# Altium schematic sheet SOC_PL_Banks_66_67_68_FMC.SchDoc: Title
size 420 x 297 mm; Author: G.Kasprowicz; CompanyName: WUT ISE; DrawnBy: G.Kasprowicz; Organization: WUT ISE; Address1: PW ISE; Address2: Nowowiejska 15/19 00-665 Warsaw; Address3: gkasprow@gmail.com; DocumentNumber: 14; Revision: 2; SheetNumber: 14; SheetTotal: 40; ModifiedBy: -; CheckedDate: -; Title2: Title 2; DivGrp: WUT ISE; Designer: G.Kasprowicz; ModifiedDate: -; ProjectName: Sensor Box
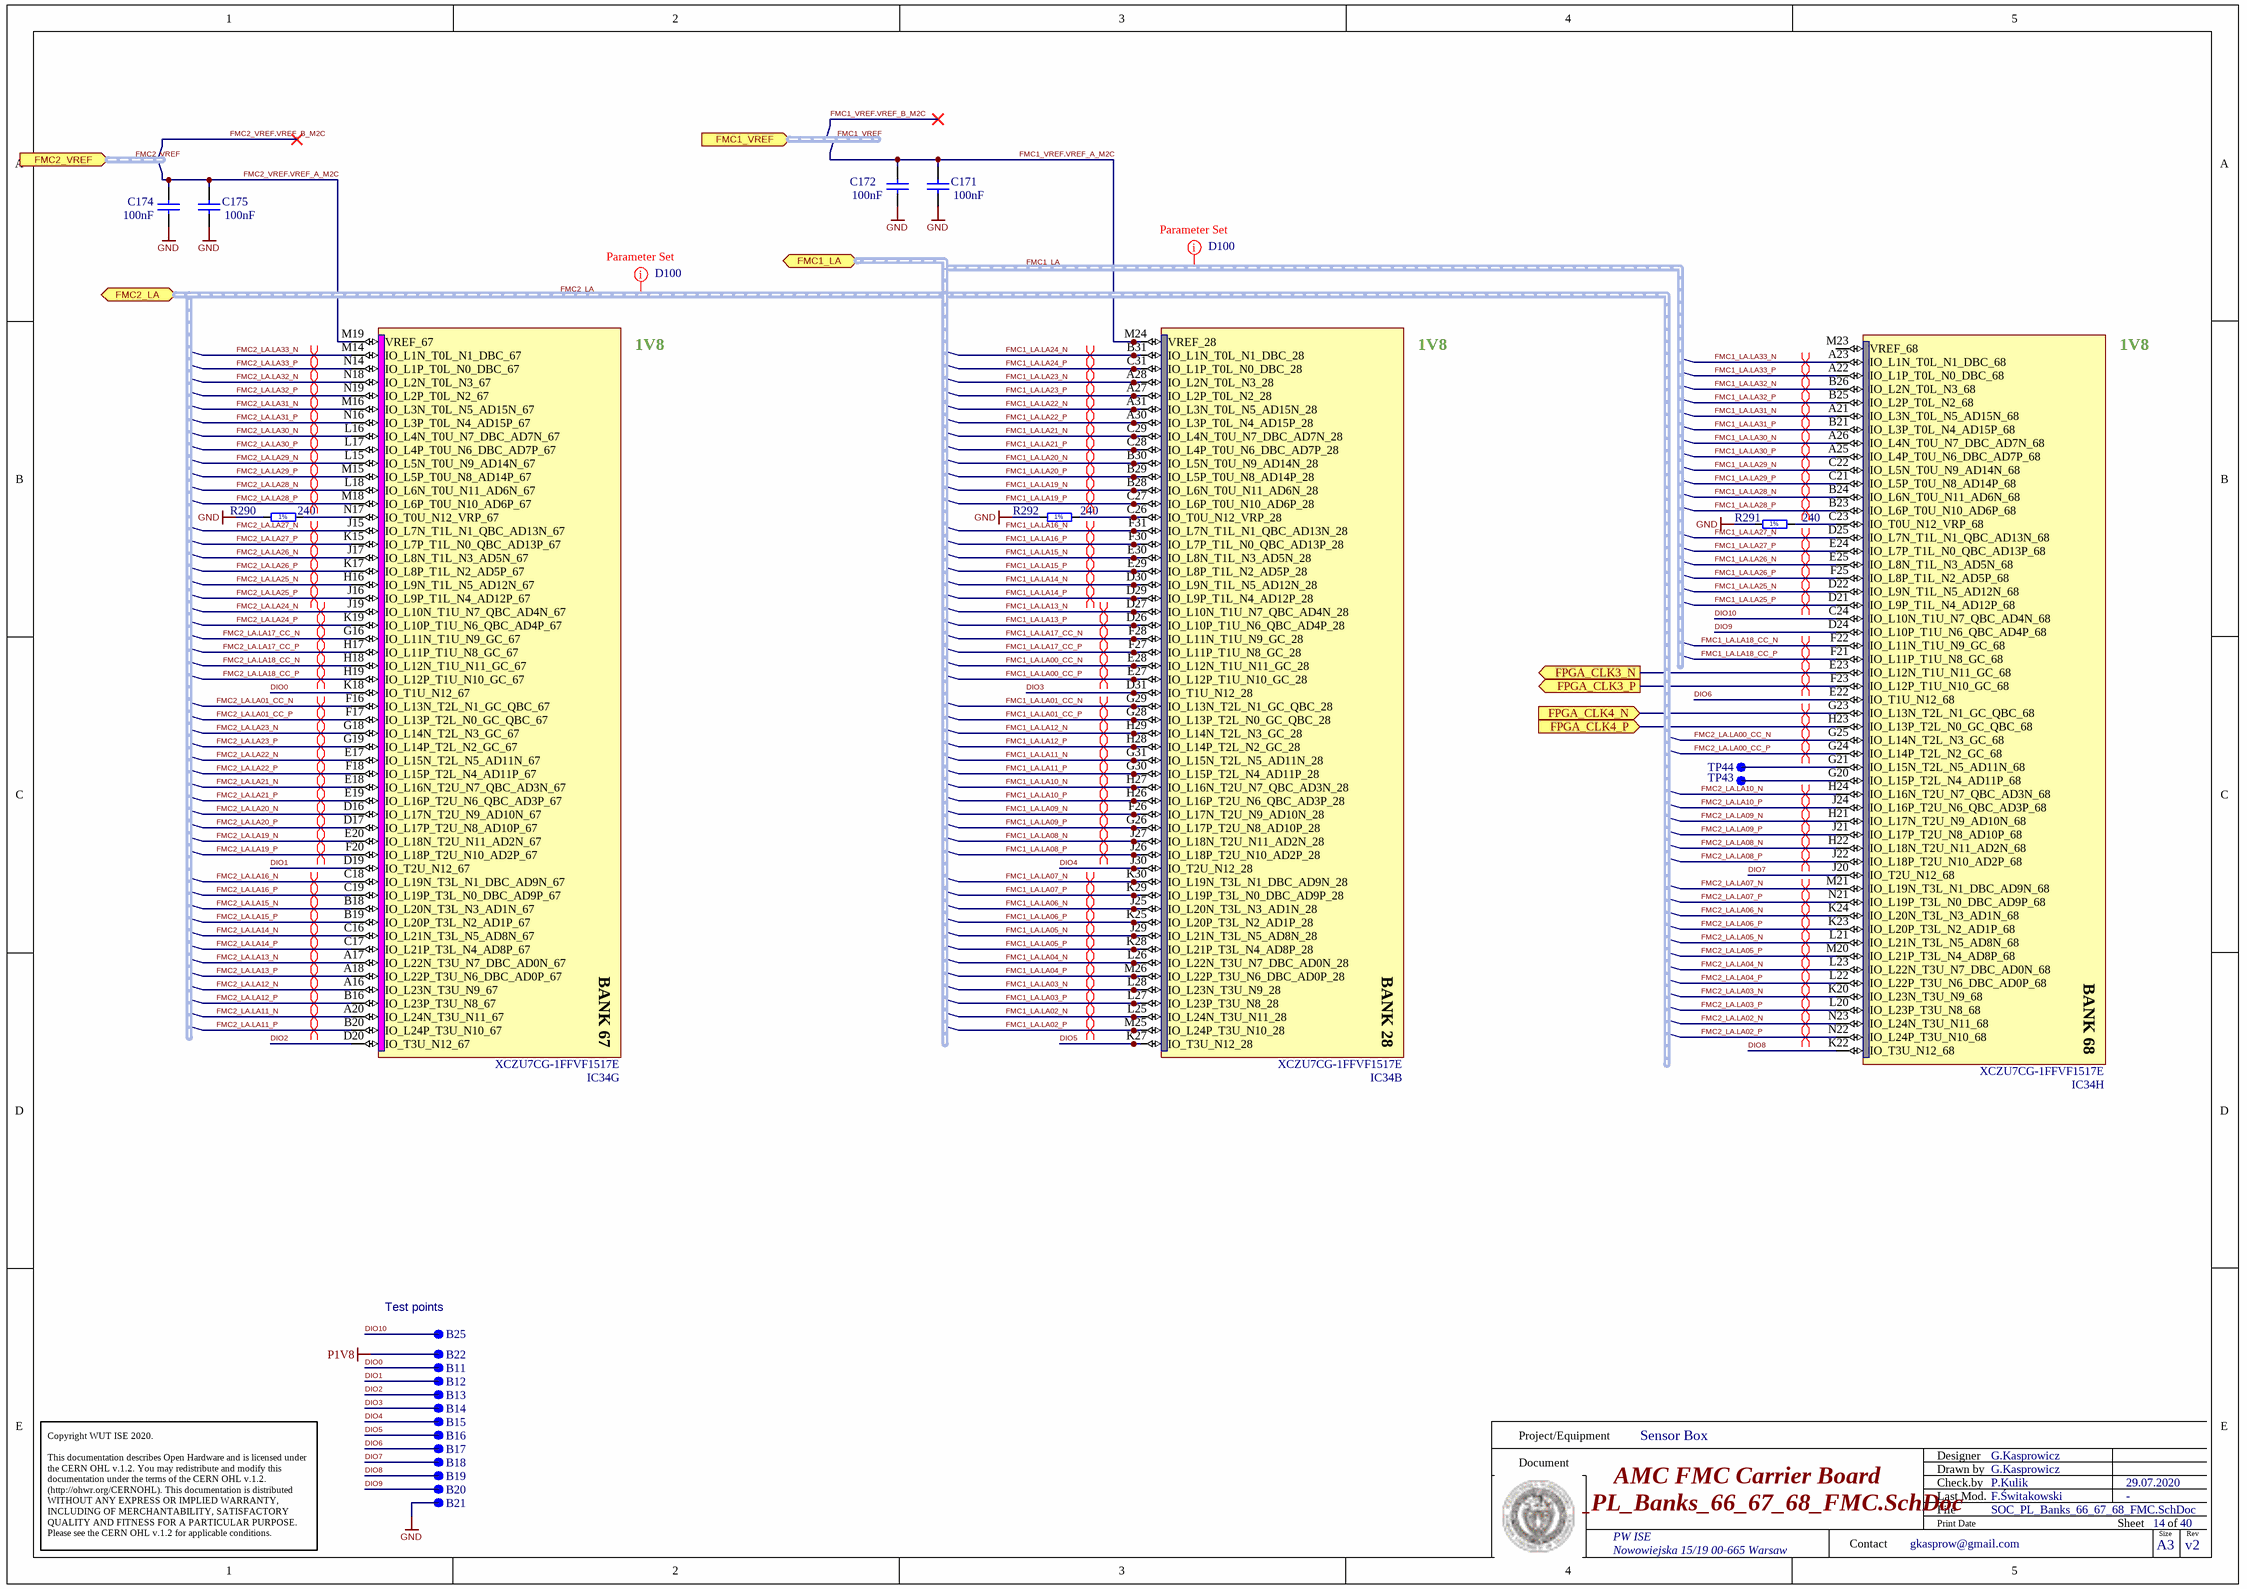
[diagram p0: SOC_PL_Banks_66_67_68_FMC.SchDoc]

## Parts
B11  SMD Pad  [C100]  (value not drawn)  (no BOM)
B12  SMD Pad  [C100]  (value not drawn)  (no BOM)
B13  SMD Pad  [C100]  (value not drawn)  (no BOM)
B14  SMD Pad  [C100]  (value not drawn)  (no BOM)
B15  SMD Pad  [C100]  (value not drawn)  (no BOM)
B16  SMD Pad  [C100]  (value not drawn)  (no BOM)
B17  SMD Pad  [C100]  (value not drawn)  (no BOM)
B18  SMD Pad  [C100]  (value not drawn)  (no BOM)
B19  SMD Pad  [C100]  (value not drawn)  (no BOM)
B20  SMD Pad  [C100]  (value not drawn)  (no BOM)
B21  SMD Pad  [C100]  (value not drawn)  (no BOM)
B22  SMD Pad  [C100]  (value not drawn)  (no BOM)
B25  SMD Pad  [C100]  (value not drawn)  (no BOM)
C171  100nF  [CAPC0603X33N]
C172  100nF  [CAPC0603X33N]
C174  100nF  [CAPC0603X33N]
C175  100nF  [CAPC0603X33N]
IC34  XCZU7CG-1FFVF1517E  [BGA1517C100P39X39_4000X4000X351]  (parts B,G,H of 28)
R290  240  [RESC1005X40N]
R291  240  [RESC1005X40N]
R292  240  [RESC1005X40N]
TP43  SMD Pad  [C100]  (value not drawn)  (no BOM)
TP44  SMD Pad  [C100]  (value not drawn)  (no BOM)

## Ports
FMC1_LA (bidir, harness FMC1_LA), FMC1_VREF (in, harness FMC1_VREF), FMC2_LA (bidir, harness FMC2_LA), FMC2_VREF (in, harness FMC2_VREF), FPGA_CLK3_N (out), FPGA_CLK3_P (out), FPGA_CLK4_N (in), FPGA_CLK4_P (in)

## Nets
GND: B21.1 C171.2 C172.2 C174.2 C175.2 R290.1 R291.1 R292.1
P1V8: B22.1
DIO0: B11.1 IC34.K18(IO_T1U_N12_67)
DIO1: B12.1 IC34.D19(IO_T2U_N12_67)
DIO2: B13.1 IC34.D20(IO_T3U_N12_67)
DIO3: B14.1 IC34.D31(IO_T1U_N12_28)
DIO4: B15.1 IC34.J30(IO_T2U_N12_28)
DIO5: B16.1 IC34.K27(IO_T3U_N12_28)
DIO6: B17.1 IC34.E22(IO_T1U_N12_68)
DIO7: B18.1 IC34.J20(IO_T2U_N12_68)
DIO8: B19.1 IC34.K22(IO_T3U_N12_68)
DIO9: B20.1 IC34.D24(IO_L10P_T1U_N6_QBC_AD4P_68)
DIO10: B25.1 IC34.C24(IO_L10N_T1U_N7_QBC_AD4N_68)
FMC1_LA.LA00_CC_N: IC34.E28(IO_L12N_T1U_N11_GC_28)
FMC1_LA.LA00_CC_P: IC34.E27(IO_L12P_T1U_N10_GC_28)
FMC1_LA.LA01_CC_N: IC34.G29(IO_L13N_T2L_N1_GC_QBC_28)
FMC1_LA.LA01_CC_P: IC34.G28(IO_L13P_T2L_N0_GC_QBC_28)
FMC1_LA.LA02_N: IC34.L25(IO_L24N_T3U_N11_28)
FMC1_LA.LA02_P: IC34.M25(IO_L24P_T3U_N10_28)
FMC1_LA.LA03_N: IC34.L28(IO_L23N_T3U_N9_28)
FMC1_LA.LA03_P: IC34.L27(IO_L23P_T3U_N8_28)
FMC1_LA.LA04_N: IC34.L26(IO_L22N_T3U_N7_DBC_AD0N_28)
FMC1_LA.LA04_P: IC34.M26(IO_L22P_T3U_N6_DBC_AD0P_28)
FMC1_LA.LA05_N: IC34.J29(IO_L21N_T3L_N5_AD8N_28)
FMC1_LA.LA05_P: IC34.K28(IO_L21P_T3L_N4_AD8P_28)
FMC1_LA.LA06_N: IC34.J25(IO_L20N_T3L_N3_AD1N_28)
FMC1_LA.LA06_P: IC34.K25(IO_L20P_T3L_N2_AD1P_28)
FMC1_LA.LA07_N: IC34.K30(IO_L19N_T3L_N1_DBC_AD9N_28)
FMC1_LA.LA07_P: IC34.K29(IO_L19P_T3L_N0_DBC_AD9P_28)
FMC1_LA.LA08_N: IC34.J27(IO_L18N_T2U_N11_AD2N_28)
FMC1_LA.LA08_P: IC34.J26(IO_L18P_T2U_N10_AD2P_28)
FMC1_LA.LA09_N: IC34.F26(IO_L17N_T2U_N9_AD10N_28)
FMC1_LA.LA09_P: IC34.G26(IO_L17P_T2U_N8_AD10P_28)
FMC1_LA.LA10_N: IC34.H27(IO_L16N_T2U_N7_QBC_AD3N_28)
FMC1_LA.LA10_P: IC34.H26(IO_L16P_T2U_N6_QBC_AD3P_28)
FMC1_LA.LA11_N: IC34.G31(IO_L15N_T2L_N5_AD11N_28)
FMC1_LA.LA11_P: IC34.G30(IO_L15P_T2L_N4_AD11P_28)
FMC1_LA.LA12_N: IC34.H29(IO_L14N_T2L_N3_GC_28)
FMC1_LA.LA12_P: IC34.H28(IO_L14P_T2L_N2_GC_28)
FMC1_LA.LA13_N: IC34.D27(IO_L10N_T1U_N7_QBC_AD4N_28)
FMC1_LA.LA13_P: IC34.D26(IO_L10P_T1U_N6_QBC_AD4P_28)
FMC1_LA.LA14_N: IC34.D30(IO_L9N_T1L_N5_AD12N_28)
FMC1_LA.LA14_P: IC34.D29(IO_L9P_T1L_N4_AD12P_28)
FMC1_LA.LA15_N: IC34.E30(IO_L8N_T1L_N3_AD5N_28)
FMC1_LA.LA15_P: IC34.E29(IO_L8P_T1L_N2_AD5P_28)
FMC1_LA.LA16_N: IC34.F31(IO_L7N_T1L_N1_QBC_AD13N_28)
FMC1_LA.LA16_P: IC34.F30(IO_L7P_T1L_N0_QBC_AD13P_28)
FMC1_LA.LA17_CC_N: IC34.F28(IO_L11N_T1U_N9_GC_28)
FMC1_LA.LA17_CC_P: IC34.F27(IO_L11P_T1U_N8_GC_28)
FMC1_LA.LA18_CC_N: IC34.F22(IO_L11N_T1U_N9_GC_68)
FMC1_LA.LA18_CC_P: IC34.F21(IO_L11P_T1U_N8_GC_68)
FMC1_LA.LA19_N: IC34.B28(IO_L6N_T0U_N11_AD6N_28)
FMC1_LA.LA19_P: IC34.C27(IO_L6P_T0U_N10_AD6P_28)
FMC1_LA.LA20_N: IC34.B30(IO_L5N_T0U_N9_AD14N_28)
FMC1_LA.LA20_P: IC34.B29(IO_L5P_T0U_N8_AD14P_28)
FMC1_LA.LA21_N: IC34.C29(IO_L4N_T0U_N7_DBC_AD7N_28)
FMC1_LA.LA21_P: IC34.C28(IO_L4P_T0U_N6_DBC_AD7P_28)
FMC1_LA.LA22_N: IC34.A31(IO_L3N_T0L_N5_AD15N_28)
FMC1_LA.LA22_P: IC34.A30(IO_L3P_T0L_N4_AD15P_28)
FMC1_LA.LA23_N: IC34.A28(IO_L2N_T0L_N3_28)
FMC1_LA.LA23_P: IC34.A27(IO_L2P_T0L_N2_28)
FMC1_LA.LA24_N: IC34.B31(IO_L1N_T0L_N1_DBC_28)
FMC1_LA.LA24_P: IC34.C31(IO_L1P_T0L_N0_DBC_28)
FMC1_LA.LA25_N: IC34.D22(IO_L9N_T1L_N5_AD12N_68)
FMC1_LA.LA25_P: IC34.D21(IO_L9P_T1L_N4_AD12P_68)
FMC1_LA.LA26_N: IC34.E25(IO_L8N_T1L_N3_AD5N_68)
FMC1_LA.LA26_P: IC34.F25(IO_L8P_T1L_N2_AD5P_68)
FMC1_LA.LA27_N: IC34.D25(IO_L7N_T1L_N1_QBC_AD13N_68)
FMC1_LA.LA27_P: IC34.E24(IO_L7P_T1L_N0_QBC_AD13P_68)
FMC1_LA.LA28_N: IC34.B24(IO_L6N_T0U_N11_AD6N_68)
FMC1_LA.LA28_P: IC34.B23(IO_L6P_T0U_N10_AD6P_68)
FMC1_LA.LA29_N: IC34.C22(IO_L5N_T0U_N9_AD14N_68)
FMC1_LA.LA29_P: IC34.C21(IO_L5P_T0U_N8_AD14P_68)
FMC1_LA.LA30_N: IC34.A26(IO_L4N_T0U_N7_DBC_AD7N_68)
FMC1_LA.LA30_P: IC34.A25(IO_L4P_T0U_N6_DBC_AD7P_68)
FMC1_LA.LA31_N: IC34.A21(IO_L3N_T0L_N5_AD15N_68)
FMC1_LA.LA31_P: IC34.B21(IO_L3P_T0L_N4_AD15P_68)
FMC1_LA.LA32_N: IC34.B26(IO_L2N_T0L_N3_68)
FMC1_LA.LA32_P: IC34.B25(IO_L2P_T0L_N2_68)
FMC1_LA.LA33_N: IC34.A23(IO_L1N_T0L_N1_DBC_68)
FMC1_LA.LA33_P: IC34.A22(IO_L1P_T0L_N0_DBC_68)
FMC1_VREF.VREF_A_M2C: C171.1 C172.1 IC34.M24(VREF_28)
FMC2_LA.LA00_CC_N: IC34.G25(IO_L14N_T2L_N3_GC_68)
FMC2_LA.LA00_CC_P: IC34.G24(IO_L14P_T2L_N2_GC_68)
FMC2_LA.LA01_CC_N: IC34.F16(IO_L13N_T2L_N1_GC_QBC_67)
FMC2_LA.LA01_CC_P: IC34.F17(IO_L13P_T2L_N0_GC_QBC_67)
FMC2_LA.LA02_N: IC34.N23(IO_L24N_T3U_N11_68)
FMC2_LA.LA02_P: IC34.N22(IO_L24P_T3U_N10_68)
FMC2_LA.LA03_N: IC34.K20(IO_L23N_T3U_N9_68)
FMC2_LA.LA03_P: IC34.L20(IO_L23P_T3U_N8_68)
FMC2_LA.LA04_N: IC34.L23(IO_L22N_T3U_N7_DBC_AD0N_68)
FMC2_LA.LA04_P: IC34.L22(IO_L22P_T3U_N6_DBC_AD0P_68)
FMC2_LA.LA05_N: IC34.L21(IO_L21N_T3L_N5_AD8N_68)
FMC2_LA.LA05_P: IC34.M20(IO_L21P_T3L_N4_AD8P_68)
FMC2_LA.LA06_N: IC34.K24(IO_L20N_T3L_N3_AD1N_68)
FMC2_LA.LA06_P: IC34.K23(IO_L20P_T3L_N2_AD1P_68)
FMC2_LA.LA07_N: IC34.M21(IO_L19N_T3L_N1_DBC_AD9N_68)
FMC2_LA.LA07_P: IC34.N21(IO_L19P_T3L_N0_DBC_AD9P_68)
FMC2_LA.LA08_N: IC34.H22(IO_L18N_T2U_N11_AD2N_68)
FMC2_LA.LA08_P: IC34.J22(IO_L18P_T2U_N10_AD2P_68)
FMC2_LA.LA09_N: IC34.H21(IO_L17N_T2U_N9_AD10N_68)
FMC2_LA.LA09_P: IC34.J21(IO_L17P_T2U_N8_AD10P_68)
FMC2_LA.LA10_N: IC34.H24(IO_L16N_T2U_N7_QBC_AD3N_68)
FMC2_LA.LA10_P: IC34.J24(IO_L16P_T2U_N6_QBC_AD3P_68)
FMC2_LA.LA11_N: IC34.A20(IO_L24N_T3U_N11_67)
FMC2_LA.LA11_P: IC34.B20(IO_L24P_T3U_N10_67)
FMC2_LA.LA12_N: IC34.A16(IO_L23N_T3U_N9_67)
FMC2_LA.LA12_P: IC34.B16(IO_L23P_T3U_N8_67)
FMC2_LA.LA13_N: IC34.A17(IO_L22N_T3U_N7_DBC_AD0N_67)
FMC2_LA.LA13_P: IC34.A18(IO_L22P_T3U_N6_DBC_AD0P_67)
FMC2_LA.LA14_N: IC34.C16(IO_L21N_T3L_N5_AD8N_67)
FMC2_LA.LA14_P: IC34.C17(IO_L21P_T3L_N4_AD8P_67)
FMC2_LA.LA15_N: IC34.B18(IO_L20N_T3L_N3_AD1N_67)
FMC2_LA.LA15_P: IC34.B19(IO_L20P_T3L_N2_AD1P_67)
FMC2_LA.LA16_N: IC34.C18(IO_L19N_T3L_N1_DBC_AD9N_67)
FMC2_LA.LA16_P: IC34.C19(IO_L19P_T3L_N0_DBC_AD9P_67)
FMC2_LA.LA17_CC_N: IC34.G16(IO_L11N_T1U_N9_GC_67)
FMC2_LA.LA17_CC_P: IC34.H17(IO_L11P_T1U_N8_GC_67)
FMC2_LA.LA18_CC_N: IC34.H18(IO_L12N_T1U_N11_GC_67)
FMC2_LA.LA18_CC_P: IC34.H19(IO_L12P_T1U_N10_GC_67)
FMC2_LA.LA19_N: IC34.E20(IO_L18N_T2U_N11_AD2N_67)
FMC2_LA.LA19_P: IC34.F20(IO_L18P_T2U_N10_AD2P_67)
FMC2_LA.LA20_N: IC34.D16(IO_L17N_T2U_N9_AD10N_67)
FMC2_LA.LA20_P: IC34.D17(IO_L17P_T2U_N8_AD10P_67)
FMC2_LA.LA21_N: IC34.E18(IO_L16N_T2U_N7_QBC_AD3N_67)
FMC2_LA.LA21_P: IC34.E19(IO_L16P_T2U_N6_QBC_AD3P_67)
FMC2_LA.LA22_N: IC34.E17(IO_L15N_T2L_N5_AD11N_67)
FMC2_LA.LA22_P: IC34.F18(IO_L15P_T2L_N4_AD11P_67)
FMC2_LA.LA23_N: IC34.G18(IO_L14N_T2L_N3_GC_67)
FMC2_LA.LA23_P: IC34.G19(IO_L14P_T2L_N2_GC_67)
FMC2_LA.LA24_N: IC34.J19(IO_L10N_T1U_N7_QBC_AD4N_67)
FMC2_LA.LA24_P: IC34.K19(IO_L10P_T1U_N6_QBC_AD4P_67)
FMC2_LA.LA25_N: IC34.H16(IO_L9N_T1L_N5_AD12N_67)
FMC2_LA.LA25_P: IC34.J16(IO_L9P_T1L_N4_AD12P_67)
FMC2_LA.LA26_N: IC34.J17(IO_L8N_T1L_N3_AD5N_67)
FMC2_LA.LA26_P: IC34.K17(IO_L8P_T1L_N2_AD5P_67)
FMC2_LA.LA27_N: IC34.J15(IO_L7N_T1L_N1_QBC_AD13N_67)
FMC2_LA.LA27_P: IC34.K15(IO_L7P_T1L_N0_QBC_AD13P_67)
FMC2_LA.LA28_N: IC34.L18(IO_L6N_T0U_N11_AD6N_67)
FMC2_LA.LA28_P: IC34.M18(IO_L6P_T0U_N10_AD6P_67)
FMC2_LA.LA29_N: IC34.L15(IO_L5N_T0U_N9_AD14N_67)
FMC2_LA.LA29_P: IC34.M15(IO_L5P_T0U_N8_AD14P_67)
FMC2_LA.LA30_N: IC34.L16(IO_L4N_T0U_N7_DBC_AD7N_67)
FMC2_LA.LA30_P: IC34.L17(IO_L4P_T0U_N6_DBC_AD7P_67)
FMC2_LA.LA31_N: IC34.M16(IO_L3N_T0L_N5_AD15N_67)
FMC2_LA.LA31_P: IC34.N16(IO_L3P_T0L_N4_AD15P_67)
FMC2_LA.LA32_N: IC34.N18(IO_L2N_T0L_N3_67)
FMC2_LA.LA32_P: IC34.N19(IO_L2P_T0L_N2_67)
FMC2_LA.LA33_N: IC34.M14(IO_L1N_T0L_N1_DBC_67)
FMC2_LA.LA33_P: IC34.N14(IO_L1P_T0L_N0_DBC_67)
FMC2_VREF.VREF_A_M2C: C174.1 C175.1 IC34.M19(VREF_67)
FPGA_CLK3_N: IC34.E23(IO_L12N_T1U_N11_GC_68) ; port FPGA_CLK3_N
FPGA_CLK3_P: IC34.F23(IO_L12P_T1U_N10_GC_68) ; port FPGA_CLK3_P
FPGA_CLK4_N: IC34.G23(IO_L13N_T2L_N1_GC_QBC_68) ; port FPGA_CLK4_N
FPGA_CLK4_P: IC34.H23(IO_L13P_T2L_N0_GC_QBC_68) ; port FPGA_CLK4_P
NetIC34_C23: IC34.C23(IO_T0U_N12_VRP_68) R291.2
NetIC34_C26: IC34.C26(IO_T0U_N12_VRP_28) R292.2
NetIC34_G20: IC34.G20(IO_L15P_T2L_N4_AD11P_68) TP43.1
NetIC34_G21: IC34.G21(IO_L15N_T2L_N5_AD11N_68) TP44.1
NetIC34_N17: IC34.N17(IO_T0U_N12_VRP_67) R290.2

Not connected (* = marked no-connect by the designer): IC34 M23(VREF_68)

## Buses and harness runs
harness FMC1_LA = port FMC1_LA
harness FMC1_VREF = port FMC1_VREF
harness FMC2_LA = port FMC2_LA
harness FMC2_VREF = port FMC2_VREF

## Layout directives
differential pair: FMC1_LA.LA00_CC_N, FMC1_LA.LA00_CC_P, FMC1_LA.LA01_CC_N, FMC1_LA.LA01_CC_P, FMC1_LA.LA02_N, FMC1_LA.LA02_P, FMC1_LA.LA03_N, FMC1_LA.LA03_P, FMC1_LA.LA04_N, FMC1_LA.LA04_P, FMC1_LA.LA05_N, FMC1_LA.LA05_P, FMC1_LA.LA06_N, FMC1_LA.LA06_P, FMC1_LA.LA07_N, FMC1_LA.LA07_P, FMC1_LA.LA08_N, FMC1_LA.LA08_P, FMC1_LA.LA09_N, FMC1_LA.LA09_P, FMC1_LA.LA10_N, FMC1_LA.LA10_P, FMC1_LA.LA11_N, FMC1_LA.LA11_P, FMC1_LA.LA12_N, FMC1_LA.LA12_P, FMC1_LA.LA13_N, FMC1_LA.LA13_P, FMC1_LA.LA14_N, FMC1_LA.LA14_P, FMC1_LA.LA15_N, FMC1_LA.LA15_P, FMC1_LA.LA16_N, FMC1_LA.LA16_P, FMC1_LA.LA17_CC_N, FMC1_LA.LA17_CC_P, FMC1_LA.LA18_CC_N, FMC1_LA.LA18_CC_P, FMC1_LA.LA19_N, FMC1_LA.LA19_P, FMC1_LA.LA20_N, FMC1_LA.LA20_P, FMC1_LA.LA21_N, FMC1_LA.LA21_P, FMC1_LA.LA22_N, FMC1_LA.LA22_P, FMC1_LA.LA23_N, FMC1_LA.LA23_P, FMC1_LA.LA24_N, FMC1_LA.LA24_P, FMC1_LA.LA25_N, FMC1_LA.LA25_P, FMC1_LA.LA26_N, FMC1_LA.LA26_P, FMC1_LA.LA27_N, FMC1_LA.LA27_P, FMC1_LA.LA28_N, FMC1_LA.LA28_P, FMC1_LA.LA29_N, FMC1_LA.LA29_P, FMC1_LA.LA30_N, FMC1_LA.LA30_P, FMC1_LA.LA31_N, FMC1_LA.LA31_P, FMC1_LA.LA32_N, FMC1_LA.LA32_P, FMC1_LA.LA33_N, FMC1_LA.LA33_P, FMC2_LA.LA00_CC_N, FMC2_LA.LA00_CC_P, FMC2_LA.LA01_CC_N, FMC2_LA.LA01_CC_P, FMC2_LA.LA02_N, FMC2_LA.LA02_P, FMC2_LA.LA03_N, FMC2_LA.LA03_P, FMC2_LA.LA04_N, FMC2_LA.LA04_P, FMC2_LA.LA05_N, FMC2_LA.LA05_P, FMC2_LA.LA06_N, FMC2_LA.LA06_P, FMC2_LA.LA07_N, FMC2_LA.LA07_P, FMC2_LA.LA08_N, FMC2_LA.LA08_P, FMC2_LA.LA09_N, FMC2_LA.LA09_P, FMC2_LA.LA10_N, FMC2_LA.LA10_P, FMC2_LA.LA11_N, FMC2_LA.LA11_P, FMC2_LA.LA12_N, FMC2_LA.LA12_P, FMC2_LA.LA13_N, FMC2_LA.LA13_P, FMC2_LA.LA14_N, FMC2_LA.LA14_P, FMC2_LA.LA15_N, FMC2_LA.LA15_P, FMC2_LA.LA16_N, FMC2_LA.LA16_P, FMC2_LA.LA17_CC_N, FMC2_LA.LA17_CC_P, FMC2_LA.LA18_CC_N, FMC2_LA.LA18_CC_P, FMC2_LA.LA19_N, FMC2_LA.LA19_P, FMC2_LA.LA20_N, FMC2_LA.LA20_P, FMC2_LA.LA21_N, FMC2_LA.LA21_P, FMC2_LA.LA22_N, FMC2_LA.LA22_P, FMC2_LA.LA23_N, FMC2_LA.LA23_P, FMC2_LA.LA24_N, FMC2_LA.LA24_P, FMC2_LA.LA25_N, FMC2_LA.LA25_P, FMC2_LA.LA26_N, FMC2_LA.LA26_P, FMC2_LA.LA27_N, FMC2_LA.LA27_P, FMC2_LA.LA28_N, FMC2_LA.LA28_P, FMC2_LA.LA29_N, FMC2_LA.LA29_P, FMC2_LA.LA30_N, FMC2_LA.LA30_P, FMC2_LA.LA31_N, FMC2_LA.LA31_P, FMC2_LA.LA32_N, FMC2_LA.LA32_P, FMC2_LA.LA33_N, FMC2_LA.LA33_P, FPGA_CLK3_N, FPGA_CLK3_P, FPGA_CLK4_N, FPGA_CLK4_P
net class D100: (no net found under the mark)

## Notes on the sheet
- 1V8
- (near B25) Test points
- Project/Equipment
- Document
- AMC FMC Carrier Board
- Designer
- Drawn by
- Check.by
- P.Kulik
- 29.07.2020
- Copyright WUT ISE 2020.
  This documentation describes Open Hardware and is licensed under the CERN OHL v.1.2. You may redistribute and modify this documentation under the terms of the CERN OHL v.1.2. (http://ohwr.org/CERNOHL). This documentation is distributed WITHOUT ANY EXPRESS OR IMPLIED WARRANTY, INCLUDING OF MERCHANTABILITY, SATISFACTORY QUALITY AND FITNESS FOR A PARTICULAR PURPOSE. Please see the CERN OHL v.1.2 for applicable conditions.
- Contact
- File
- Last Mod.
- Print Date
- F.Świtakowski
- Sheet
- Size
- A3
- of
- v2
- Rev
- (in symbol R0402_240R_1%_0.0625W_100PPM) 1%
- (in symbol XCZU7CG-1FFVF1517E, part B) BANK 28
- (in symbol XCZU7CG-1FFVF1517E, part G) BANK 67
- (in symbol XCZU7CG-1FFVF1517E, part H) BANK 68

## Library data of the parts
B11-B22 B25 TP43 TP44 = SMD_PAD_D1MM: Through Hole Pad; Part Description: 1mm Diameter SMD Pad; Mounted: No; PackageDescription: 1mm Diameter SMD Pad; Part Number: SMD_PAD_D1MM; Component Type: Standard (No BOM); Pin Count: 1; Family: SMD Pad; Socket: No; SMD: No; Sense: No; Status: None; ComponentHeight: 0mm; HelpURL: Undefined; Author: CERN DEM JLC; CreateDate: 10/10/2017; LatestRevisionDate: 10/10/2017
C171 C172 C175 = CC0201_100NF_6.3V_10%_X5R: Non-polarised capacitor; Manufacturer: GENERIC; Manufacturer1 Part Number: 02016D104KAT2A; Part Description: SMD Multilayer Chip Ceramic Capacitor; TC: X5R; Tolerance: ±10%; Voltage: 6.3V; Author: CERN DEM JLC; Case: 0201; Component Kind: Standard; Component Type: Standard; CreateDate: 03/12/2007; HelpURL: \\cern.ch\dfs\Applications\Altium\Datasheets\CC0201_X5R_AVX.pdf; LatestRevisionDate: 03/12/2007; Manufacturer Part Number: CC0201_100NF_6.3V_10%_X5R; Manufacturer1 ComponentHeight: 0.33mm; Manufacturer1 Example: AVX; Mounted: Yes; Part Number: CC0201_100NF_6.3V_10%_X5R; Pin Count: 2; SMD: Yes; Socket: No; Status: Not Recommended; Value: 100nF; Sense: No
C174 = CC0201_100NF_6.3V_10%_X5R: Non-polarised capacitor; Manufacturer: GENERIC; Part Description: SMD Multilayer Chip Ceramic Capacitor; Manufacturer1 Part Number: 02016D104KAT2A; Tolerance: ±10%; Voltage: 6.3V; TC: X5R; Manufacturer Part Number: CC0201_100NF_6.3V_10%_X5R; Part Number: CC0201_100NF_6.3V_10%_X5R; Value: 100nF; Component Kind: Standard; Component Type: Standard; Pin Count: 2; Status: Not Recommended; Case: 0201; Mounted: Yes; Socket: No; SMD: Yes; Sense: No; Manufacturer1 Example: AVX; Manufacturer1 ComponentHeight: 0.33mm; HelpURL: \\cern.ch\dfs\Applications\Altium\Datasheets\CC0201_X5R_AVX.pdf; Author: CERN DEM JLC; CreateDate: 03/12/2007; LatestRevisionDate: 03/12/2007
IC34 = XCZU7CG-1FFVF1517E: Zynq UltraScale+ RFSoC, Quad-Core ARM® Cortex™-A53 MPCore™ up to 1.5GHz, 214 PS I/O, 416 HP I/O, 48 HD I/O, 1517-Pin BGA; Part Description: Zynq UltraScale+ MPSoC, Quad-Core ARM® Cortex™-A53 MPCore™ up to 1.5GHz, 214 PS I/O, 416 HP I/O, 48 HD I/O, 1517-Pin BGA; Manufacturer: XILINX; PressFit: No; Bonding: No; Part Number: XCZU7CG-1FFVF1517E; Component Kind: Standard; Component Type: Standard; Device: XCZU7CG-1FFVF1517E; PackageDescription: BGA, 1.00mm Pitch, Square; 1517 Pin, 39 Columns X 39 Rows, Body 40.00mm X 40.00mm X 3.51mm H, IPC Medium Density; Manufacturer Part Number: XCZU7CG-1FFVF1517E; Pin Count: 1517; Case: BGA1517; Mounted: Yes; Socket: No; SMD: Yes; Sense: No; ComponentHeight: 3.51mm; HelpURL: \\cern.ch\dfs\Applications\Altium\Datasheets\XCZU7CG-1FFVF1517E.pdf; ComponentLink1URL: \\cern.ch\dfs\Applications\Altium\Datasheets\XCZU7CG-1FFVF1517E_Package-Pinout.pdf; ComponentLink1Description: Package/Pinout; ComponentLink2URL: \\cern.ch\dfs\Applications\Altium\Datasheets\XCZU7CG-1FFVF1517E_Pinout.pdf; ComponentLink2Description: Pinout; Author: CERN DEM BC; CreateDate: 10.07.2019; LatestRevisionDate: 10.07.2019
R290-R292 = R0402_240R_1%_0.0625W_100PPM: Resistor - 1%; Manufacturer: GENERIC; Part Description: General Purpose Thick Film Chip Resistor; Manufacturer1 Part Number: 232270672401L; TC: ±100ppm/°C; PressFit: No; Manufacturer Part Number: R0402_240R_1%_0.0625W_100PPM; Part Number: R0402_240R_1%_0.0625W_100PPM; Tolerance: ±1%; Value: 240; Component Kind: Standard; Component Type: Standard; Pin Count: 2; Status: Not Recommended; Power: 0.0625W; Case: 0402; Mounted: Yes; Sense: No; Socket: No; SMD: Yes; Manufacturer1 Example: YAGEO PHYCOMP; Manufacturer1 ComponentHeight: 0.4mm; HelpURL: \\cern.ch\dfs\Applications\Altium\Datasheets\R0402_Phycomp_RC0402.pdf; Author: CERN DEM JLC; CreateDate: 03/12/2007; LatestRevisionDate: 17/10/2012